# EasyEDA Pro project 嵌入式.eprj, board 显示
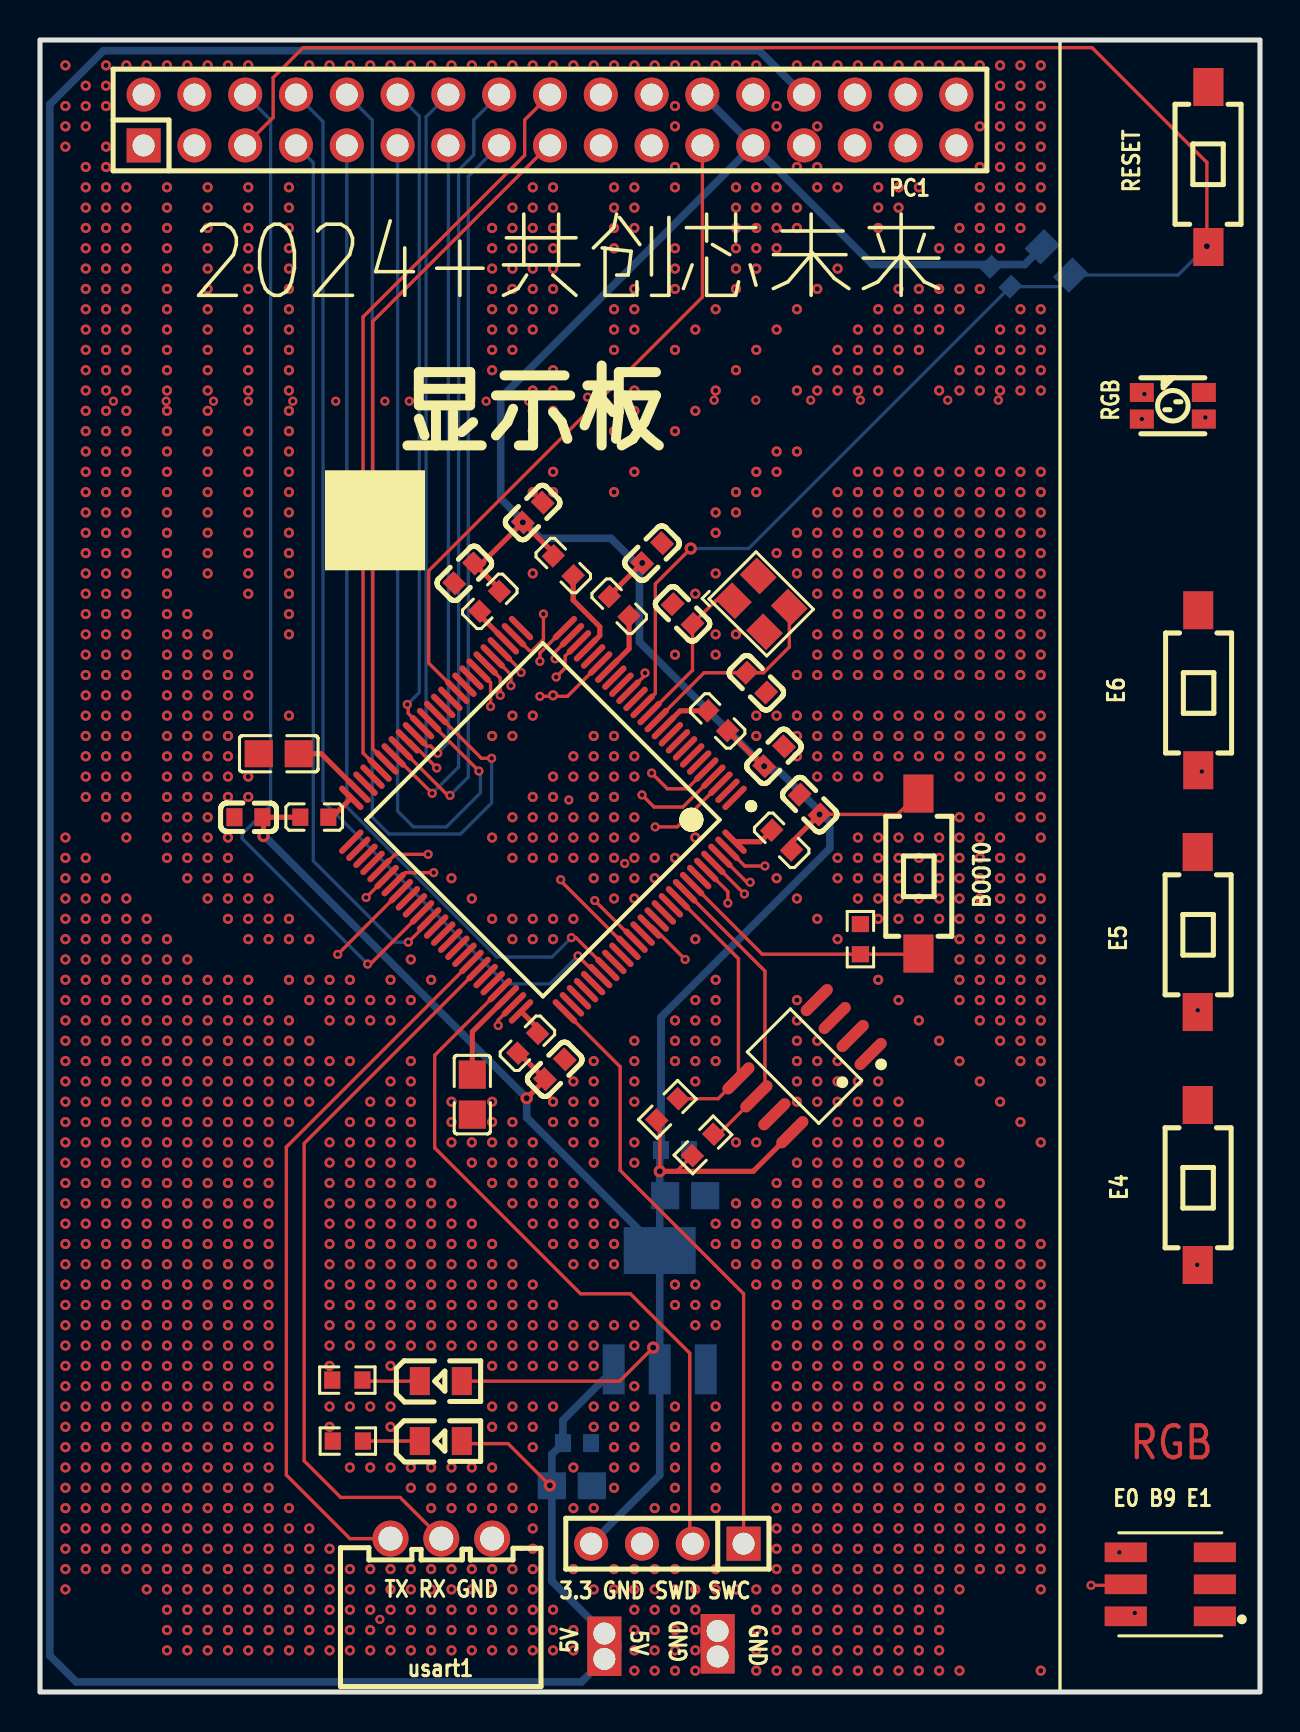
[diagram p4: board, top side]
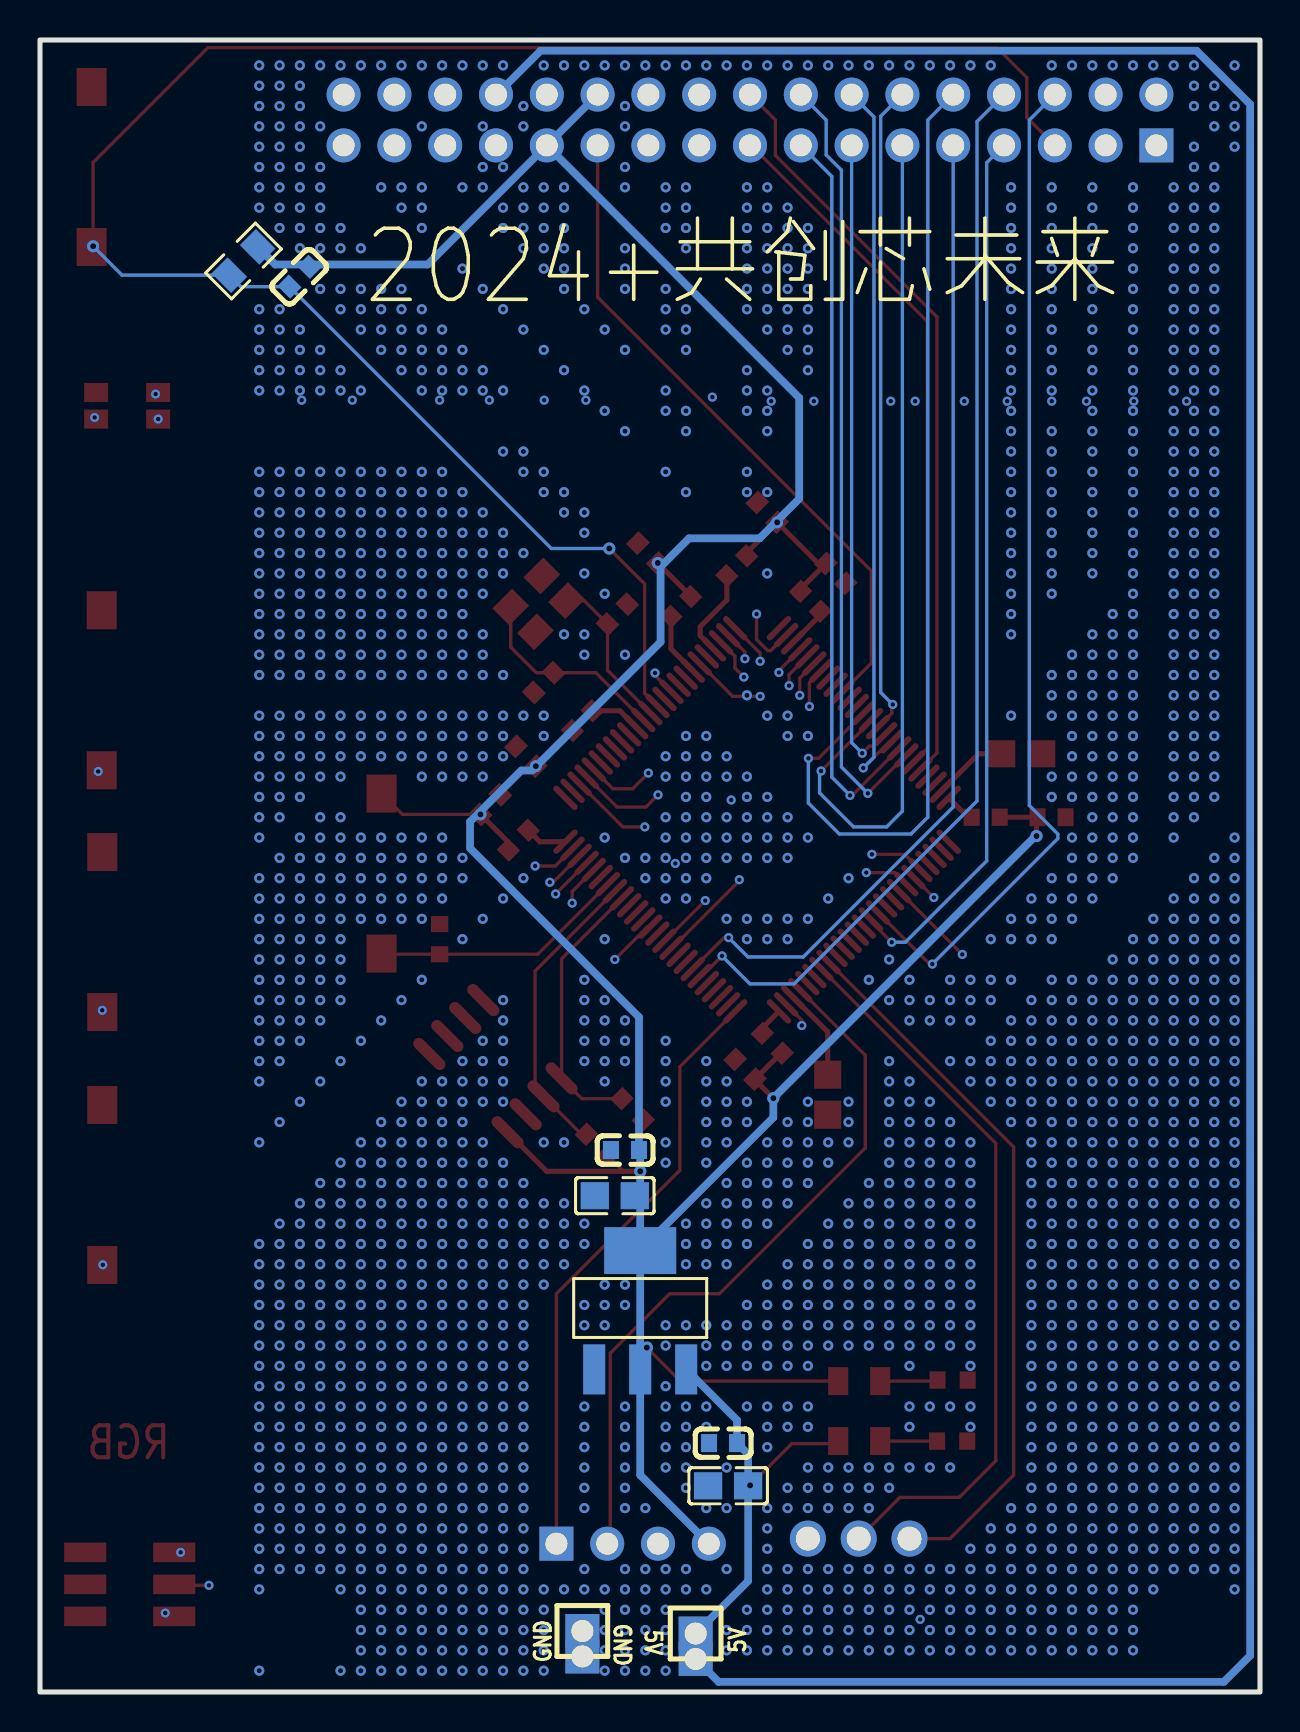
[diagram p5: board, bottom side, seen from below]

Outline 61 x 82.6 mm; copper layers: Top Layer, Inner1, Inner2, Bottom Layer. Coordinates in mm from the lower left corner of the outline.
Outline path: rectangle 0,82.6 61,0
Stack: Top Layer 0.035mm 外层铜厚1oz / Dielectric1 0.2104mm 7628 RC49% 8.6mil / Inner1 0.0152mm 内层铜厚 / Dielectric2 1.065mm 1.1mm H/HOZ 含铜 / Inner2 0.0152mm 内层铜厚 / Dielectric3 0.2104mm 7628 RC49% 8.6mil / Bottom Layer 0.035mm 外层铜厚1oz

## Design rules (mm)
template: 自定义配置
spacing copperThickness1oz (default): track to track 0.102, other pairs 0.152 to 0.3
spacing copperThickness2oz: track to track 0.203, other pairs 0.152 to 0.3
track width copperThickness1oz (default): min 0.127, default 0.254, max 2.54
track width copperThickness2oz: min 0.203, default 0.254, max 2.54
differential pair differentialPair (default): width min 0.127, default 0.254, max 2.54; gap min 0.152, default 0.152
via viaSize (default): diameter min 0.001, default 0.61, max 10; hole min 0.001, default 0.305, max 6.3

## Placement (name value [footprint] x y rotation side)
C5  10pF  [C0603]  35.81 50.47 135 top
C6  10pF  [C0603]  32.13 53.9 315 top
C7  100nF  [C0603]  36.7 46.79 45 top
C8  100nF  [C0603]  30.61 56.95 45 top
C9  100nF  [C0603]  24.64 58.98 45 top
C10  100nF  [C0603]  21.21 55.93 225 top
C11  100nF  [C0603]  10.42 43.74 180 top
C12  100nF  [C0603]  25.74 31.14 45 top
C13  100nF  [C0603]  38.48 44.37 135 top
C14  2.2uF  [C0805]  21.62 29.87 90 top
C15  2.2uF  [C0805]  11.94 46.91 180 top
C18  100nF  [C0603]  26.85 12.44 0 bottom
C19  1uF  [C0805]  26.59 10.31 180 bottom
C20  100nF  [C0603]  31.75 27.1 0 bottom
C21  1uF  [C0805]  32.26 24.81 180 bottom
C22  100nF  [C0603]  48.03 70.76 135 bottom
CN1  XH-3AW  [CONN-TH_3P-P2.54_HCTL_XH-3AW]  20.07 7.67 180 top
H1  PZ254V-11-04P  [HDR-TH_4P-P2.54-V-M]  31.37 7.42 180 top
H2  PZ254V-11-01P  [HDR-TH_1P-P2.54-V-M]  28.22 2.92 180 bottom
H3  PZ254V-11-01P  [HDR-TH_1P-P2.54-V-M]  33.88 3.05 180 bottom
L3  2.2nH  [L0603]  33.88 48.56 135 top
L4  2.2nH  [L0603]  28.96 54.28 315 top
L5  2.2nH  [L0603]  26.16 56.31 315 top
L6  2.2nH  [L0603]  22.48 54.53 225 top
L7  2.2nH  [L0603]  13.72 43.74 0 top
L8  2.2nH  [L0603]  24.38 32.44 45 top
L9  2.2nH  [L0603]  37.08 42.59 135 top
LED1  XL-5050RGBC  [LED-ARRAY-SMD_6P-L5.0-W5.0-TL-RD_3]  56.52 5.38 180 top
LED2  NCD0805R1  [LED0805-R-RD]  20.04 15.54 0 top
LED3  NCD0805R1  [LED0805-R-RD]  20.04 12.55 0 top
LED5  MHPA3528RGBCT  [LED-ARRAY-SMD_4P-L3.5-W2.8-TL]  56.64 64.31 0 top
NOREF  -  [Pad_e144048]  33.88 1.78 180 top
NOREF#2  -  [Pad_e144050]  28.22 1.65 180 top
R4  10kΩ  [R0603]  31.37 29.13 45 top
R5  10kΩ  [R0603]  33.15 27.36 45 top
R6  10kΩ  [R0805]  50.83 71.55 135 bottom
R7  10kΩ  [R0603]  41.02 37.64 90 top
R8  10kΩ  [R0603]  15.37 15.59 0 top
R9  10kΩ  [R0603]  15.39 12.55 0 top
SW2  TS-1101-C-W  [SW-SMD_L6.0-W3.3-LS8.0]  58.42 76.25 270 top
SW3  TS-1101-C-W  [SW-SMD_L6.0-W3.3-LS8.0]  43.92 40.92 90 top
SW4  TS-1101-C-W  [SW-SMD_L6.0-W3.3-LS8.0]  57.89 25.35 90 top
SW5  TS-1101-C-W  [SW-SMD_L6.0-W3.3-LS8.0]  57.91 50.09 90 top
SW6  TS-1101-C-W  [SW-SMD_L6.0-W3.3-LS8.0]  57.89 38 90 top
U1  STM32F407VGT6  [LQFP-100_L14.0-W14.0-P0.50-LS16.0-BL]  25.15 43.61 135 top
U2  PM254-2-17-Z-8.5  [HDR-TH_34P-P2.54-V-F-R2-C17-S2.54-1]  25.5 78.6 0 top
U3  AMS1117-3.3  [SOT-223-3_L6.5-W3.5-P3.05-LS7.0]  30.99 19.1 270 bottom
U4  AT24C02  [SOP-8_L5.0-W4.0-P1.27-LS6.0-BL]  38.23 31.29 135 top
X3  8MHz  [OSC-SMD_4P-L3.2-W2.5-BL]  36.07 54.41 315 top

## Footprints (pads in the part's own frame, mm; a bottom-side part is the same pattern mirrored in y, then rotated)
C0603
  rect 0.8x0.9 smd: 1(-0.7,0) 2(0.7,0)
C0805
  rect 1.41x1.35 smd: 1(-1,0) 2(1,0)
CONN-TH_3P-P2.54_HCTL_XH-3AW
  round 1.8 hole 1.199: 1(-2.54,0) 2(0.002,0) 3(2.54,0)
HDR-TH_1P-P2.54-V-M
  rect 1.7x1.7 hole 1.1: 1(0,0)
HDR-TH_4P-P2.54-V-M
  rect 1.7x1.7 hole 1.1: 1(-3.81,0)
  round 1.7 hole 1.1: 2(-1.27,0) 3(1.27,0) 4(3.81,0)
HDR-TH_34P-P2.54-V-F-R2-C17-S2.54-1
  rect 1.7x1.7 hole 1.1: 1(-20.32,-1.27)
  round 1.7 hole 1.1: 2(-17.78,-1.27) 3(-15.24,-1.27) 4(-12.7,-1.27) 5(-10.16,-1.27) 6(-7.62,-1.27) 7(-5.08,-1.27) 8(-2.54,-1.27) 9(0,-1.27) 10(2.54,-1.27) 11(5.08,-1.27) 12(7.62,-1.27) 13(10.16,-1.27) 14(12.7,-1.27) 15(15.24,-1.27) 16(17.78,-1.27) 17(20.32,-1.27) 18(20.32,1.27) 19(17.78,1.27) 20(15.24,1.27) 21(12.7,1.27) 22(10.16,1.27) 23(7.62,1.27) 24(5.08,1.27) 25(2.54,1.27) 26(0,1.27) 27(-2.54,1.27) 28(-5.08,1.27) 29(-7.62,1.27) 30(-10.16,1.27) 31(-12.7,1.27) 32(-15.24,1.27) 33(-17.78,1.27) 34(-20.32,1.27)
L0603
  rect 0.8x0.864 smd: 1(-0.7,0) 2(0.7,0)
LED0805-R-RD
  rect 1x1.399 smd: 1(1.05,0) 2(-1.05,0)
LED-ARRAY-SMD_4P-L3.5-W2.8-TL
  rect 1.2x0.95 smd: 1(1.55,0.665) 2(1.55,-0.665) 3(-1.55,-0.665) 4(-1.55,0.665)
LED-ARRAY-SMD_6P-L5.0-W5.0-TL-RD_3
  rect 2.105x0.98 smd: 1(-2.228,1.6) 2(-2.228,0) 3(-2.228,-1.6) 4(2.228,-1.6) 5(2.228,0) 6(2.228,1.6)
LQFP-100_L14.0-W14.0-P0.50-LS16.0-BL
  oval 0.3x1.6 smd: 1(-6,-7.55) 2(-5.5,-7.55) 3(-5,-7.55) 4(-4.5,-7.55) 5(-4,-7.55) 6(-3.5,-7.55) 7(-3,-7.55) 8(-2.5,-7.55) 9(-2,-7.55) 10(-1.5,-7.55) 11(-1,-7.55) 12(-0.5,-7.55) 13(0,-7.55) 14(0.5,-7.55) 15(1,-7.55) 16(1.5,-7.55) 17(2,-7.55) 18(2.5,-7.55) 19(3,-7.55) 20(3.5,-7.55) 21(4,-7.55) 22(4.5,-7.55) 23(5,-7.55) 24(5.5,-7.55) 25(6,-7.55) 51(6,7.55) 52(5.5,7.55) 53(5,7.55) 54(4.5,7.55) 55(4,7.55) 56(3.5,7.55) 57(3,7.55) 58(2.5,7.55) 59(2,7.55) 60(1.5,7.55) 61(1,7.55) 62(0.5,7.55) 63(0,7.55) 64(-0.5,7.55) 65(-1,7.55) 66(-1.5,7.55) 67(-2,7.55) 68(-2.5,7.55) 69(-3,7.55) 70(-3.5,7.55) 71(-4,7.55) 72(-4.5,7.55) 73(-5,7.55) 74(-5.5,7.55) 75(-6,7.55)
  oval 1.6x0.3 smd: 26(7.55,-6) 27(7.55,-5.5) 28(7.55,-5) 29(7.55,-4.5) 30(7.55,-4) 31(7.55,-3.5) 32(7.55,-3) 33(7.55,-2.5) 34(7.55,-2) 35(7.55,-1.5) 36(7.55,-1) 37(7.55,-0.5) 38(7.55,0) 39(7.55,0.5) 40(7.55,1) 41(7.55,1.5) 42(7.55,2) 43(7.55,2.5) 44(7.55,3) 45(7.55,3.5) 46(7.55,4) 47(7.55,4.5) 48(7.55,5) 49(7.55,5.5) 50(7.55,6) 76(-7.55,6) 77(-7.55,5.5) 78(-7.55,5) 79(-7.55,4.5) 80(-7.55,4) 81(-7.55,3.5) 82(-7.55,3) 83(-7.55,2.5) 84(-7.55,2) 85(-7.55,1.5) 86(-7.55,1) 87(-7.55,0.5) 88(-7.55,0) 89(-7.55,-0.5) 90(-7.55,-1) 91(-7.55,-1.5) 92(-7.55,-2) 93(-7.55,-2.5) 94(-7.55,-3) 95(-7.55,-3.5) 96(-7.55,-4) 97(-7.55,-4.5) 98(-7.55,-5) 99(-7.55,-5.5) 100(-7.55,-6)
OSC-SMD_4P-L3.2-W2.5-BL
  rect 1.4x1.2 smd: 1(-1.1,-0.875) 2(1.1,-0.875) 3(1.1,0.875) 4(-1.1,0.875)
Pad_e144048
  rect 1.7x1.7 hole 1.1: 1(0,0)
Pad_e144050
  rect 1.7x1.7 hole 1.1: 2(0,0)
R0603
  rect 0.806x0.864 smd: 1(-0.753,0) 2(0.753,0)
R0805
  rect 1.133x1.377 smd: 1(-1,0) 2(1,0)
SOP-8_L5.0-W4.0-P1.27-LS6.0-BL
  oval 0.574x2.035 smd: 1(-1.905,-2.768) 2(-0.635,-2.768) 3(0.635,-2.768) 4(1.905,-2.768) 5(1.905,2.768) 6(0.635,2.768) 7(-0.635,2.768) 8(-1.905,2.768)
SOT-223-3_L6.5-W3.5-P3.05-LS7.0
  rect 2.5x1.1 smd: 1(2.97,-2.3) 2(2.97,0) 3(2.97,2.3)
  rect 2.34x3.6 smd: 4(-2.97,0)
SW-SMD_L6.0-W3.3-LS8.0
  rect 1.9x1.5 smd: 1(-4,0) 2(4,0)

## Nets
As in the schematic, except:
5V: C18.1 C19.2 H2.1 LED3.1 NOREF#2.2 U2.21 U3.3
VSS: C5.1 C6.1 C7.2 C8.2 C9.2 C10.2 C11.2 C12.2 C13.2 C14.1 C15.2 C18.2 C19.1 C20.2 C21.1 CN1.1 H1.3 H3.1 LED1.1 LED1.2 LED1.3 LED5.1 NOREF.1 R7.2 R8.1 R9.1 SW2.1 SW4.2 SW5.2 SW6.2 U1.10 U1.20 U1.27 U1.74 U1.99 U2.14 U2.22 U2.24 U3.1 U4.1 U4.2 U4.3 U4.4 U4.7 X3.2 X3.4

Pads without a net: U1 1 2 6 7 8 9 15 17 18 26 33 34 36 37 47 48 51 52 53 54 59 60 63 64 65 66 67 70 71 77 78 79 80 83 84 87 89 90 91 95

## Via types
v1: diameter 0.508, hole 0.254, Top Layer to Bottom Layer, 2019 vias
v2: diameter 0.457, hole 0.229, Top Layer to Bottom Layer, 65 vias
v3: diameter 0.61, hole 0.305, Top Layer to Bottom Layer, 11 vias
